# EAGLE schematic Resistor_Resistor (EAGLE 8.3.0), part 7 of 43
## Parts (continued)
R8784  10K  RESISTOR_0201  [0201]
R8785  10K  RESISTOR_0201  [0201]
R8786  10K  RESISTOR_0201  [0201]
R8787  10K  RESISTOR_0201  [0201]
R8788  10K  RESISTOR_0201  [0201]
R8789  10K  RESISTOR_0201  [0201]
R8790  10K  RESISTOR_0201  [0201]
R8791  10K  RESISTOR_0201  [0201]
R8792  10K  RESISTOR_0201  [0201]
R8793  10K  RESISTOR_0201  [0201]
R8794  10K  RESISTOR_0201  [0201]
R8795  10K  RESISTOR_0201  [0201]
R8796  10K  RESISTOR_0201  [0201]
R8797  10K  RESISTOR_0201  [0201]
R8798  10K  RESISTOR_0201  [0201]
R8799  10K  RESISTOR_0201  [0201]
R8800  10K  RESISTOR_0201  [0201]
R8801  10K  RESISTOR_0201  [0201]
R8802  10K  RESISTOR_0201  [0201]
R8803  10K  RESISTOR_0201  [0201]
R8804  10K  RESISTOR_0201  [0201]
R8805  10K  RESISTOR_0201  [0201]
R8806  10K  RESISTOR_0201  [0201]
R8807  10K  RESISTOR_0201  [0201]
R8808  10K  RESISTOR_0201  [0201]
R8809  10K  RESISTOR_0201  [0201]
R8810  10K  RESISTOR_0201  [0201]
R8811  10K  RESISTOR_0201  [0201]
R8812  10K  RESISTOR_0201  [0201]
R8813  10K  RESISTOR_0201  [0201]
R8814  10K  RESISTOR_0201  [0201]
R8815  10K  RESISTOR_0201  [0201]
R8816  10K  RESISTOR_0201  [0201]
R8817  10K  RESISTOR_0201  [0201]
R8818  10K  RESISTOR_0201  [0201]
R8819  10K  RESISTOR_0201  [0201]
R8820  10K  RESISTOR_0201  [0201]
R8821  10K  RESISTOR_0201  [0201]
R8822  10K  RESISTOR_0201  [0201]
R8823  10K  RESISTOR_0201  [0201]
R8824  10K  RESISTOR_0201  [0201]
R8825  10K  RESISTOR_0201  [0201]
R8826  10K  RESISTOR_0201  [0201]
R8827  10K  RESISTOR_0201  [0201]
R8828  10K  RESISTOR_0201  [0201]
R8829  10K  RESISTOR_0201  [0201]
R8830  10K  RESISTOR_0201  [0201]
R8831  10K  RESISTOR_0201  [0201]
R8832  10K  RESISTOR_0201  [0201]
R8833  10K  RESISTOR_0201  [0201]
R8834  10K  RESISTOR_0201  [0201]
R8835  10K  RESISTOR_0201  [0201]
R8836  10K  RESISTOR_0201  [0201]
R8837  10K  RESISTOR_0201  [0201]
R8838  10K  RESISTOR_0201  [0201]
R8839  10K  RESISTOR_0201  [0201]
R8840  10K  RESISTOR_0201  [0201]
R8841  10K  RESISTOR_0201  [0201]
R8842  10K  RESISTOR_0201  [0201]
R8843  10K  RESISTOR_0201  [0201]
R8844  10K  RESISTOR_0201  [0201]
R8845  10K  RESISTOR_0201  [0201]
R8846  10K  RESISTOR_0201  [0201]
R8847  10K  RESISTOR_0201  [0201]
R8848  10K  RESISTOR_0201  [0201]
R8849  10K  RESISTOR_0201  [0201]
R8850  10K  RESISTOR_0201  [0201]
R8851  10K  RESISTOR_0201  [0201]
R8852  10K  RESISTOR_0201  [0201]
R8853  10K  RESISTOR_0201  [0201]
R8854  10K  RESISTOR_0201  [0201]
R8855  10K  RESISTOR_0201  [0201]
R8856  10K  RESISTOR_0201  [0201]
R8857  10K  RESISTOR_0201  [0201]
R8858  10K  RESISTOR_0201  [0201]
R8859  10K  RESISTOR_0201  [0201]
R8860  10K  RESISTOR_0201  [0201]
R8861  10K  RESISTOR_0201  [0201]
R8862  10K  RESISTOR_0201  [0201]
R8863  10K  RESISTOR_0201  [0201]
R8864  10K  RESISTOR_0201  [0201]
R8865  10K  RESISTOR_0201  [0201]
R8866  10K  RESISTOR_0201  [0201]
R8867  10K  RESISTOR_0201  [0201]
R8868  10K  RESISTOR_0201  [0201]
R8869  10K  RESISTOR_0201  [0201]
R8870  10K  RESISTOR_0201  [0201]
R8871  10K  RESISTOR_0201  [0201]
R8872  10K  RESISTOR_0201  [0201]
R8873  10K  RESISTOR_0201  [0201]
R8874  10K  RESISTOR_0201  [0201]
R8875  10K  RESISTOR_0201  [0201]
R8876  10K  RESISTOR_0201  [0201]
R8877  10K  RESISTOR_0201  [0201]
R8878  10K  RESISTOR_0201  [0201]
R8879  10K  RESISTOR_0201  [0201]
R8880  10K  RESISTOR_0201  [0201]
R8881  10K  RESISTOR_0201  [0201]
R8882  10K  RESISTOR_0201  [0201]
R8883  10K  RESISTOR_0201  [0201]
R8884  10K  RESISTOR_0201  [0201]
R8885  10K  RESISTOR_0201  [0201]
R8886  10K  RESISTOR_0201  [0201]
R8887  10K  RESISTOR_0201  [0201]
R8888  10K  RESISTOR_0201  [0201]
R8889  10K  RESISTOR_0201  [0201]
R8890  10K  RESISTOR_0201  [0201]
R8891  10K  RESISTOR_0201  [0201]
R8892  10K  RESISTOR_0201  [0201]
R8893  10K  RESISTOR_0201  [0201]
R8894  10K  RESISTOR_0201  [0201]
R8895  10K  RESISTOR_0201  [0201]
R8896  10K  RESISTOR_0201  [0201]
R8897  10K  RESISTOR_0201  [0201]
R8898  10K  RESISTOR_0201  [0201]
R8899  10K  RESISTOR_0201  [0201]
R8900  10K  RESISTOR_0201  [0201]
R8901  10K  RESISTOR_0201  [0201]
R8902  10K  RESISTOR_0201  [0201]
R8903  10K  RESISTOR_0201  [0201]
R8904  10K  RESISTOR_0201  [0201]
R8905  10K  RESISTOR_0201  [0201]
R8906  10K  RESISTOR_0201  [0201]
R8907  10K  RESISTOR_0201  [0201]
R8908  10K  RESISTOR_0201  [0201]
R8909  10K  RESISTOR_0201  [0201]
R8910  10K  RESISTOR_0201  [0201]
R8911  10K  RESISTOR_0201  [0201]
R8912  10K  RESISTOR_0201  [0201]
R8913  10K  RESISTOR_0201  [0201]
R8914  10K  RESISTOR_0201  [0201]
R8915  10K  RESISTOR_0201  [0201]
R8916  10K  RESISTOR_0201  [0201]
R8917  10K  RESISTOR_0201  [0201]
R8918  10K  RESISTOR_0201  [0201]
R8919  10K  RESISTOR_0201  [0201]
R8920  10K  RESISTOR_0201  [0201]
R8921  10K  RESISTOR_0201  [0201]
R8922  10K  RESISTOR_0201  [0201]
R8923  10K  RESISTOR_0201  [0201]
R8924  10K  RESISTOR_0201  [0201]
R8925  10K  RESISTOR_0201  [0201]
R8926  10K  RESISTOR_0201  [0201]
R8927  10K  RESISTOR_0201  [0201]
R8928  10K  RESISTOR_0201  [0201]
R8929  10K  RESISTOR_0201  [0201]
R8930  10K  RESISTOR_0201  [0201]
R8931  10K  RESISTOR_0201  [0201]
R8932  10K  RESISTOR_0201  [0201]
R8933  10K  RESISTOR_0201  [0201]
R8934  10K  RESISTOR_0201  [0201]
R8935  10K  RESISTOR_0201  [0201]
R8936  10K  RESISTOR_0201  [0201]
R8937  10K  RESISTOR_0201  [0201]
R8938  10K  RESISTOR_0201  [0201]
R8939  10K  RESISTOR_0201  [0201]
R8940  10K  RESISTOR_0201  [0201]
R8941  10K  RESISTOR_0201  [0201]
R8942  10K  RESISTOR_0201  [0201]
R8943  10K  RESISTOR_0201  [0201]
R8944  10K  RESISTOR_0201  [0201]
R8945  10K  RESISTOR_0201  [0201]
R8946  10K  RESISTOR_0201  [0201]
R8947  10K  RESISTOR_0201  [0201]
R8948  10K  RESISTOR_0201  [0201]
R8949  10K  RESISTOR_0201  [0201]
R8950  10K  RESISTOR_0201  [0201]
R8951  10K  RESISTOR_0201  [0201]
R8952  10K  RESISTOR_0201  [0201]
R8953  10K  RESISTOR_0201  [0201]
R8954  10K  RESISTOR_0201  [0201]
R8955  10K  RESISTOR_0201  [0201]
R8956  10K  RESISTOR_0201  [0201]
R8957  10K  RESISTOR_0201  [0201]
R8958  10K  RESISTOR_0201  [0201]
R8959  10K  RESISTOR_0201  [0201]
R8960  10K  RESISTOR_0201  [0201]
R8961  10K  RESISTOR_0201  [0201]
R8962  10K  RESISTOR_0201  [0201]
R8963  10K  RESISTOR_0201  [0201]
R8964  10K  RESISTOR_0201  [0201]
R8965  10K  RESISTOR_0201  [0201]
R8966  10K  RESISTOR_0201  [0201]
R8967  10K  RESISTOR_0201  [0201]
R8968  10K  RESISTOR_0201  [0201]
R8969  10K  RESISTOR_0201  [0201]
R8970  10K  RESISTOR_0201  [0201]
R8971  10K  RESISTOR_0201  [0201]
R8972  10K  RESISTOR_0201  [0201]
R8973  10K  RESISTOR_0201  [0201]
R8974  10K  RESISTOR_0201  [0201]
R8975  10K  RESISTOR_0201  [0201]
R8976  10K  RESISTOR_0201  [0201]
R8977  10K  RESISTOR_0201  [0201]
R8978  10K  RESISTOR_0201  [0201]
R8979  10K  RESISTOR_0201  [0201]
R8980  10K  RESISTOR_0201  [0201]
R8981  10K  RESISTOR_0201  [0201]
R8982  10K  RESISTOR_0201  [0201]
R8983  10K  RESISTOR_0201  [0201]
R8984  10K  RESISTOR_0201  [0201]
R8985  10K  RESISTOR_0201  [0201]
R8986  10K  RESISTOR_0201  [0201]
R8987  10K  RESISTOR_0201  [0201]
R8988  10K  RESISTOR_0201  [0201]
R8989  10K  RESISTOR_0201  [0201]
R8990  10K  RESISTOR_0201  [0201]
R8991  10K  RESISTOR_0201  [0201]
R8992  10K  RESISTOR_0201  [0201]
R8993  10K  RESISTOR_0201  [0201]
R8994  10K  RESISTOR_0201  [0201]
R8995  10K  RESISTOR_0201  [0201]
R8996  10K  RESISTOR_0201  [0201]
R8997  10K  RESISTOR_0201  [0201]
R8998  10K  RESISTOR_0201  [0201]
R8999  10K  RESISTOR_0201  [0201]
R9000  10K  RESISTOR_0201  [0201]
R9001  10K  RESISTOR_0201  [0201]
R9002  10K  RESISTOR_0201  [0201]
R9003  10K  RESISTOR_0201  [0201]
R9004  10K  RESISTOR_0201  [0201]
R9005  10K  RESISTOR_0201  [0201]
R9006  10K  RESISTOR_0201  [0201]
R9007  10K  RESISTOR_0201  [0201]
R9008  10K  RESISTOR_0201  [0201]
R9009  10K  RESISTOR_0201  [0201]
R9010  10K  RESISTOR_0201  [0201]
R9011  10K  RESISTOR_0201  [0201]
R9012  10K  RESISTOR_0201  [0201]
R9013  10K  RESISTOR_0201  [0201]
R9014  10K  RESISTOR_0201  [0201]
R9015  10K  RESISTOR_0201  [0201]
R9016  10K  RESISTOR_0201  [0201]
R9017  10K  RESISTOR_0201  [0201]
R9018  10K  RESISTOR_0201  [0201]
R9019  10K  RESISTOR_0201  [0201]
R9020  10K  RESISTOR_0201  [0201]
R9021  10K  RESISTOR_0201  [0201]
R9022  10K  RESISTOR_0201  [0201]
R9023  10K  RESISTOR_0201  [0201]
R9024  10K  RESISTOR_0201  [0201]
R9025  10K  RESISTOR_0201  [0201]
R9026  10K  RESISTOR_0201  [0201]
R9027  10K  RESISTOR_0201  [0201]
R9028  10K  RESISTOR_0201  [0201]
R9029  10K  RESISTOR_0201  [0201]
R9030  10K  RESISTOR_0201  [0201]
R9031  10K  RESISTOR_0201  [0201]
R9032  10K  RESISTOR_0201  [0201]
R9033  10K  RESISTOR_0201  [0201]
R9034  10K  RESISTOR_0201  [0201]
R9035  10K  RESISTOR_0201  [0201]
R9036  10K  RESISTOR_0201  [0201]
R9037  10K  RESISTOR_0201  [0201]
R9038  10K  RESISTOR_0201  [0201]
R9039  10K  RESISTOR_0201  [0201]
R9040  10K  RESISTOR_0201  [0201]
R9041  10K  RESISTOR_0201  [0201]
R9042  10K  RESISTOR_0201  [0201]
R9043  10K  RESISTOR_0201  [0201]
R9044  10K  RESISTOR_0201  [0201]
R9045  10K  RESISTOR_0201  [0201]
R9046  10K  RESISTOR_0201  [0201]
R9047  10K  RESISTOR_0201  [0201]
R9048  10K  RESISTOR_0201  [0201]
R9049  10K  RESISTOR_0201  [0201]
R9050  10K  RESISTOR_0201  [0201]
R9051  10K  RESISTOR_0201  [0201]
R9052  10K  RESISTOR_0201  [0201]
R9053  10K  RESISTOR_0201  [0201]
R9054  10K  RESISTOR_0201  [0201]
R9055  10K  RESISTOR_0201  [0201]
R9056  10K  RESISTOR_0201  [0201]
R9057  10K  RESISTOR_0201  [0201]
R9058  10K  RESISTOR_0201  [0201]
R9059  10K  RESISTOR_0201  [0201]
R9060  10K  RESISTOR_0201  [0201]
R9061  10K  RESISTOR_0201  [0201]
R9062  10K  RESISTOR_0201  [0201]
R9063  10K  RESISTOR_0201  [0201]
R9064  10K  RESISTOR_0201  [0201]
R9065  10K  RESISTOR_0201  [0201]
R9066  10K  RESISTOR_0201  [0201]
R9067  10K  RESISTOR_0201  [0201]
R9068  10K  RESISTOR_0201  [0201]
R9069  10K  RESISTOR_0201  [0201]
R9070  10K  RESISTOR_0201  [0201]
R9071  10K  RESISTOR_0201  [0201]
R9072  10K  RESISTOR_0201  [0201]
R9073  10K  RESISTOR_0201  [0201]
R9074  10K  RESISTOR_0201  [0201]
R9075  10K  RESISTOR_0201  [0201]
R9076  10K  RESISTOR_0201  [0201]
R9077  10K  RESISTOR_0201  [0201]
R9078  10K  RESISTOR_0201  [0201]
R9079  10K  RESISTOR_0201  [0201]
R9080  10K  RESISTOR_0201  [0201]
R9081  10K  RESISTOR_0201  [0201]
R9082  10K  RESISTOR_0201  [0201]
R9083  10K  RESISTOR_0201  [0201]
R9084  10K  RESISTOR_0201  [0201]
R9085  10K  RESISTOR_0201  [0201]
R9086  10K  RESISTOR_0201  [0201]
R9087  10K  RESISTOR_0201  [0201]
R9088  10K  RESISTOR_0201  [0201]
R9089  10K  RESISTOR_0201  [0201]
R9090  10K  RESISTOR_0201  [0201]
R9091  10K  RESISTOR_0201  [0201]
R9092  10K  RESISTOR_0201  [0201]
R9093  10K  RESISTOR_0201  [0201]
R9094  10K  RESISTOR_0201  [0201]
R9095  10K  RESISTOR_0201  [0201]
R9096  10K  RESISTOR_0201  [0201]
R9097  10K  RESISTOR_0201  [0201]
R9098  10K  RESISTOR_0201  [0201]
R9099  10K  RESISTOR_0201  [0201]
R9100  10K  RESISTOR_0201  [0201]
R9101  10K  RESISTOR_0201  [0201]
R9102  10K  RESISTOR_0201  [0201]
R9103  10K  RESISTOR_0201  [0201]
R9104  10K  RESISTOR_0201  [0201]
R9105  10K  RESISTOR_0201  [0201]
R9106  10K  RESISTOR_0201  [0201]
R9107  10K  RESISTOR_0201  [0201]
R9108  10K  RESISTOR_0201  [0201]
R9109  10K  RESISTOR_0201  [0201]
R9110  10K  RESISTOR_0201  [0201]
R9111  10K  RESISTOR_0201  [0201]
R9112  10K  RESISTOR_0201  [0201]
R9113  10K  RESISTOR_0201  [0201]
R9114  10K  RESISTOR_0201  [0201]
R9115  10K  RESISTOR_0201  [0201]
R9116  10K  RESISTOR_0201  [0201]
R9117  10K  RESISTOR_0201  [0201]
R9118  10K  RESISTOR_0201  [0201]
R9119  10K  RESISTOR_0201  [0201]
R9120  10K  RESISTOR_0201  [0201]
R9121  10K  RESISTOR_0201  [0201]
R9122  10K  RESISTOR_0201  [0201]
R9123  10K  RESISTOR_0201  [0201]
R9124  10K  RESISTOR_0201  [0201]
R9125  10K  RESISTOR_0201  [0201]
R9126  10K  RESISTOR_0201  [0201]
R9127  10K  RESISTOR_0201  [0201]
R9128  10K  RESISTOR_0201  [0201]
R9129  10K  RESISTOR_0201  [0201]
R9130  10K  RESISTOR_0201  [0201]
R9131  10K  RESISTOR_0201  [0201]
R9132  10K  RESISTOR_0201  [0201]
R9133  10K  RESISTOR_0201  [0201]
R9134  10K  RESISTOR_0201  [0201]
R9135  10K  RESISTOR_0201  [0201]
R9136  10K  RESISTOR_0201  [0201]
R9137  10K  RESISTOR_0201  [0201]
R9138  10K  RESISTOR_0201  [0201]
R9139  10K  RESISTOR_0201  [0201]
R9140  10K  RESISTOR_0201  [0201]
R9141  10K  RESISTOR_0201  [0201]
R9142  10K  RESISTOR_0201  [0201]
R9143  10K  RESISTOR_0201  [0201]
R9144  10K  RESISTOR_0201  [0201]
R9145  10K  RESISTOR_0201  [0201]
R9146  10K  RESISTOR_0201  [0201]
R9147  10K  RESISTOR_0201  [0201]
R9148  10K  RESISTOR_0201  [0201]
R9149  10K  RESISTOR_0201  [0201]
R9150  10K  RESISTOR_0201  [0201]
R9151  10K  RESISTOR_0201  [0201]
R9152  10K  RESISTOR_0201  [0201]
R9153  10K  RESISTOR_0201  [0201]
R9154  10K  RESISTOR_0201  [0201]
R9155  10K  RESISTOR_0201  [0201]
R9156  10K  RESISTOR_0201  [0201]
R9157  10K  RESISTOR_0201  [0201]
R9158  10K  RESISTOR_0201  [0201]
R9159  10K  RESISTOR_0201  [0201]
R9160  10K  RESISTOR_0201  [0201]
R9161  10K  RESISTOR_0201  [0201]
R9162  10K  RESISTOR_0201  [0201]
R9163  10K  RESISTOR_0201  [0201]
R9164  10K  RESISTOR_0201  [0201]
R9165  10K  RESISTOR_0201  [0201]
R9166  10K  RESISTOR_0201  [0201]
R9167  10K  RESISTOR_0201  [0201]
R9168  10K  RESISTOR_0201  [0201]
R9169  10K  RESISTOR_0201  [0201]
R9170  10K  RESISTOR_0201  [0201]
R9171  10K  RESISTOR_0201  [0201]
R9172  10K  RESISTOR_0201  [0201]
R9173  10K  RESISTOR_0201  [0201]
R9174  10K  RESISTOR_0201  [0201]
R9175  10K  RESISTOR_0201  [0201]
R9176  10K  RESISTOR_0201  [0201]
R9177  10K  RESISTOR_0201  [0201]
R9178  10K  RESISTOR_0201  [0201]
R9179  10K  RESISTOR_0201  [0201]
R9180  10K  RESISTOR_0201  [0201]
R9181  10K  RESISTOR_0201  [0201]
R9182  10K  RESISTOR_0201  [0201]
R9183  10K  RESISTOR_0201  [0201]
R9184  10K  RESISTOR_0201  [0201]
R9185  10K  RESISTOR_0201  [0201]
R9186  10K  RESISTOR_0201  [0201]
R9187  10K  RESISTOR_0201  [0201]
R9188  10K  RESISTOR_0201  [0201]
R9189  10K  RESISTOR_0201  [0201]
R9190  10K  RESISTOR_0201  [0201]
R9191  10K  RESISTOR_0201  [0201]
R9192  10K  RESISTOR_0201  [0201]
R9193  10K  RESISTOR_0201  [0201]
R9194  10K  RESISTOR_0201  [0201]
R9195  10K  RESISTOR_0201  [0201]
R9196  10K  RESISTOR_0201  [0201]
R9197  10K  RESISTOR_0201  [0201]
R9198  10K  RESISTOR_0201  [0201]
R9199  10K  RESISTOR_0201  [0201]
R9200  10K  RESISTOR_0201  [0201]
R9201  10K  RESISTOR_0201  [0201]
R9202  10K  RESISTOR_0201  [0201]
R9203  10K  RESISTOR_0201  [0201]
R9204  10K  RESISTOR_0201  [0201]
R9205  10K  RESISTOR_0201  [0201]
R9206  10K  RESISTOR_0201  [0201]
R9207  10K  RESISTOR_0201  [0201]
R9208  10K  RESISTOR_0201  [0201]
R9209  10K  RESISTOR_0201  [0201]
R9210  10K  RESISTOR_0201  [0201]
R9211  10K  RESISTOR_0201  [0201]
R9212  10K  RESISTOR_0201  [0201]
R9213  10K  RESISTOR_0201  [0201]
R9214  10K  RESISTOR_0201  [0201]
R9215  10K  RESISTOR_0201  [0201]
R9216  10K  RESISTOR_0201  [0201]
R9217  10K  RESISTOR_0201  [0201]
R9218  10K  RESISTOR_0201  [0201]
R9219  10K  RESISTOR_0201  [0201]
R9220  10K  RESISTOR_0201  [0201]
R9221  10K  RESISTOR_0201  [0201]
R9222  10K  RESISTOR_0201  [0201]
R9223  10K  RESISTOR_0201  [0201]
R9224  10K  RESISTOR_0201  [0201]
R9225  10K  RESISTOR_0201  [0201]
R9226  10K  RESISTOR_0201  [0201]
R9227  10K  RESISTOR_0201  [0201]
R9228  10K  RESISTOR_0201  [0201]
R9229  10K  RESISTOR_0201  [0201]
R9230  10K  RESISTOR_0201  [0201]
R9231  10K  RESISTOR_0201  [0201]
R9232  10K  RESISTOR_0201  [0201]
R9233  10K  RESISTOR_0201  [0201]
R9234  10K  RESISTOR_0201  [0201]
R9235  10K  RESISTOR_0201  [0201]
R9236  10K  RESISTOR_0201  [0201]
R9237  10K  RESISTOR_0201  [0201]
R9238  10K  RESISTOR_0201  [0201]
R9239  10K  RESISTOR_0201  [0201]
R9240  10K  RESISTOR_0201  [0201]
R9241  10K  RESISTOR_0201  [0201]
R9242  10K  RESISTOR_0201  [0201]
R9243  10K  RESISTOR_0201  [0201]
R9244  10K  RESISTOR_0201  [0201]
R9245  10K  RESISTOR_0201  [0201]
R9246  10K  RESISTOR_0201  [0201]
R9247  10K  RESISTOR_0201  [0201]
R9248  10K  RESISTOR_0201  [0201]
R9249  10K  RESISTOR_0201  [0201]
R9250  10K  RESISTOR_0201  [0201]
R9251  10K  RESISTOR_0201  [0201]
R9252  10K  RESISTOR_0201  [0201]
R9253  10K  RESISTOR_0201  [0201]
R9254  10K  RESISTOR_0201  [0201]
R9255  10K  RESISTOR_0201  [0201]
R9256  10K  RESISTOR_0201  [0201]
R9257  10K  RESISTOR_0201  [0201]
R9258  10K  RESISTOR_0201  [0201]
R9259  10K  RESISTOR_0201  [0201]
R9260  10K  RESISTOR_0201  [0201]
R9261  10K  RESISTOR_0201  [0201]
R9262  10K  RESISTOR_0201  [0201]
R9263  10K  RESISTOR_0201  [0201]
R9264  10K  RESISTOR_0201  [0201]
R9265  10K  RESISTOR_0201  [0201]
R9266  10K  RESISTOR_0201  [0201]
R9267  10K  RESISTOR_0201  [0201]
R9268  10K  RESISTOR_0201  [0201]
R9269  10K  RESISTOR_0201  [0201]
R9270  10K  RESISTOR_0201  [0201]
R9271  10K  RESISTOR_0201  [0201]
R9272  10K  RESISTOR_0201  [0201]
R9273  10K  RESISTOR_0201  [0201]
R9274  10K  RESISTOR_0201  [0201]
R9275  10K  RESISTOR_0201  [0201]
R9276  10K  RESISTOR_0201  [0201]
R9277  10K  RESISTOR_0201  [0201]
R9278  10K  RESISTOR_0201  [0201]
R9279  10K  RESISTOR_0201  [0201]
R9280  10K  RESISTOR_0201  [0201]
R9281  10K  RESISTOR_0201  [0201]
R9282  10K  RESISTOR_0201  [0201]
R9283  10K  RESISTOR_0201  [0201]
R9284  10K  RESISTOR_0201  [0201]
R9285  10K  RESISTOR_0201  [0201]
R9286  10K  RESISTOR_0201  [0201]
R9287  10K  RESISTOR_0201  [0201]
R9288  10K  RESISTOR_0201  [0201]
R9289  10K  RESISTOR_0201  [0201]
R9290  10K  RESISTOR_0201  [0201]
R9291  10K  RESISTOR_0201  [0201]
R9292  10K  RESISTOR_0201  [0201]
R9293  10K  RESISTOR_0201  [0201]
R9294  10K  RESISTOR_0201  [0201]
R9295  10K  RESISTOR_0201  [0201]
R9296  10K  RESISTOR_0201  [0201]
R9297  10K  RESISTOR_0201  [0201]
R9298  10K  RESISTOR_0201  [0201]
R9299  10K  RESISTOR_0201  [0201]
R9300  10K  RESISTOR_0201  [0201]
R9301  10K  RESISTOR_0201  [0201]
R9302  10K  RESISTOR_0201  [0201]
R9303  10K  RESISTOR_0201  [0201]
R9304  10K  RESISTOR_0201  [0201]
R9305  10K  RESISTOR_0201  [0201]
R9306  10K  RESISTOR_0201  [0201]
R9307  10K  RESISTOR_0201  [0201]
R9308  10K  RESISTOR_0201  [0201]
R9309  10K  RESISTOR_0201  [0201]
R9310  10K  RESISTOR_0201  [0201]
R9311  10K  RESISTOR_0201  [0201]
R9312  10K  RESISTOR_0201  [0201]
R9313  10K  RESISTOR_0201  [0201]
R9314  10K  RESISTOR_0201  [0201]
R9315  10K  RESISTOR_0201  [0201]
R9316  10K  RESISTOR_0201  [0201]
R9317  10K  RESISTOR_0201  [0201]
R9318  10K  RESISTOR_0201  [0201]
R9319  10K  RESISTOR_0201  [0201]
R9320  10K  RESISTOR_0201  [0201]
R9321  10K  RESISTOR_0201  [0201]
R9322  10K  RESISTOR_0201  [0201]
R9323  10K  RESISTOR_0201  [0201]
R9324  10K  RESISTOR_0201  [0201]
R9325  10K  RESISTOR_0201  [0201]
R9326  10K  RESISTOR_0201  [0201]
R9327  10K  RESISTOR_0201  [0201]
R9328  10K  RESISTOR_0201  [0201]
R9329  10K  RESISTOR_0201  [0201]
R9330  10K  RESISTOR_0201  [0201]
R9331  10K  RESISTOR_0201  [0201]
R9332  10K  RESISTOR_0201  [0201]
R9333  10K  RESISTOR_0201  [0201]
R9334  10K  RESISTOR_0201  [0201]
R9335  10K  RESISTOR_0201  [0201]
R9336  10K  RESISTOR_0201  [0201]
R9337  10K  RESISTOR_0201  [0201]
R9338  10K  RESISTOR_0201  [0201]
R9339  10K  RESISTOR_0201  [0201]
R9340  10K  RESISTOR_0201  [0201]
R9341  10K  RESISTOR_0201  [0201]
R9342  10K  RESISTOR_0201  [0201]
R9343  10K  RESISTOR_0201  [0201]
R9344  10K  RESISTOR_0201  [0201]
R9345  10K  RESISTOR_0201  [0201]
R9346  10K  RESISTOR_0201  [0201]
R9347  10K  RESISTOR_0201  [0201]
R9348  10K  RESISTOR_0201  [0201]
R9349  10K  RESISTOR_0201  [0201]
R9350  10K  RESISTOR_0201  [0201]
R9351  10K  RESISTOR_0201  [0201]
R9352  10K  RESISTOR_0201  [0201]
R9353  10K  RESISTOR_0201  [0201]
R9354  10K  RESISTOR_0201  [0201]
R9355  10K  RESISTOR_0201  [0201]
R9356  10K  RESISTOR_0201  [0201]
R9357  10K  RESISTOR_0201  [0201]
R9358  10K  RESISTOR_0201  [0201]
R9359  10K  RESISTOR_0201  [0201]
R9360  10K  RESISTOR_0201  [0201]
R9361  10K  RESISTOR_0201  [0201]
R9362  10K  RESISTOR_0201  [0201]
R9363  10K  RESISTOR_0201  [0201]
R9364  10K  RESISTOR_0201  [0201]
R9365  10K  RESISTOR_0201  [0201]
R9366  10K  RESISTOR_0201  [0201]
R9367  10K  RESISTOR_0201  [0201]
R9368  10K  RESISTOR_0201  [0201]
R9369  10K  RESISTOR_0201  [0201]
R9370  10K  RESISTOR_0201  [0201]
R9371  10K  RESISTOR_0201  [0201]
R9372  10K  RESISTOR_0201  [0201]
R9373  10K  RESISTOR_0201  [0201]
R9374  10K  RESISTOR_0201  [0201]
R9375  10K  RESISTOR_0201  [0201]
R9376  10K  RESISTOR_0201  [0201]
R9377  10K  RESISTOR_0201  [0201]
R9378  10K  RESISTOR_0201  [0201]
R9379  10K  RESISTOR_0201  [0201]
R9380  10K  RESISTOR_0201  [0201]
R9381  10K  RESISTOR_0201  [0201]
R9382  10K  RESISTOR_0201  [0201]
R9383  10K  RESISTOR_0201  [0201]
R9384  10K  RESISTOR_0201  [0201]
R9385  10K  RESISTOR_0201  [0201]
R9386  10K  RESISTOR_0201  [0201]
R9387  10K  RESISTOR_0201  [0201]
R9388  10K  RESISTOR_0201  [0201]
R9389  10K  RESISTOR_0201  [0201]
R9390  10K  RESISTOR_0201  [0201]
R9391  10K  RESISTOR_0201  [0201]
R9392  10K  RESISTOR_0201  [0201]
R9393  10K  RESISTOR_0201  [0201]
R9394  10K  RESISTOR_0201  [0201]
R9395  10K  RESISTOR_0201  [0201]
R9396  10K  RESISTOR_0201  [0201]
R9397  10K  RESISTOR_0201  [0201]
R9398  10K  RESISTOR_0201  [0201]
R9399  10K  RESISTOR_0201  [0201]
R9400  10K  RESISTOR_0201  [0201]
R9401  10K  RESISTOR_0201  [0201]
R9402  10K  RESISTOR_0201  [0201]
R9403  10K  RESISTOR_0201  [0201]
R9404  10K  RESISTOR_0201  [0201]
R9405  10K  RESISTOR_0201  [0201]
R9406  10K  RESISTOR_0201  [0201]
R9407  10K  RESISTOR_0201  [0201]
R9408  10K  RESISTOR_0201  [0201]
R9409  10K  RESISTOR_0201  [0201]
R9410  10K  RESISTOR_0201  [0201]
R9411  10K  RESISTOR_0201  [0201]
R9412  10K  RESISTOR_0201  [0201]
R9413  10K  RESISTOR_0201  [0201]
R9414  10K  RESISTOR_0201  [0201]
R9415  10K  RESISTOR_0201  [0201]
R9416  10K  RESISTOR_0201  [0201]
R9417  10K  RESISTOR_0201  [0201]
R9418  10K  RESISTOR_0201  [0201]
R9419  10K  RESISTOR_0201  [0201]
R9420  10K  RESISTOR_0201  [0201]
R9421  10K  RESISTOR_0201  [0201]
R9422  10K  RESISTOR_0201  [0201]
R9423  10K  RESISTOR_0201  [0201]
R9424  10K  RESISTOR_0201  [0201]
R9425  10K  RESISTOR_0201  [0201]
R9426  10K  RESISTOR_0201  [0201]
R9427  10K  RESISTOR_0201  [0201]
R9428  10K  RESISTOR_0201  [0201]
R9429  10K  RESISTOR_0201  [0201]
R9430  10K  RESISTOR_0201  [0201]
R9431  10K  RESISTOR_0201  [0201]
R9432  10K  RESISTOR_0201  [0201]
R9433  10K  RESISTOR_0201  [0201]
R9434  10K  RESISTOR_0201  [0201]
R9435  10K  RESISTOR_0201  [0201]
R9436  10K  RESISTOR_0201  [0201]
R9437  10K  RESISTOR_0201  [0201]
R9438  10K  RESISTOR_0201  [0201]
R9439  10K  RESISTOR_0201  [0201]
R9440  10K  RESISTOR_0201  [0201]
R9441  10K  RESISTOR_0201  [0201]
R9442  10K  RESISTOR_0201  [0201]
R9443  10K  RESISTOR_0201  [0201]
R9444  10K  RESISTOR_0201  [0201]
R9445  10K  RESISTOR_0201  [0201]
R9446  10K  RESISTOR_0201  [0201]
R9447  10K  RESISTOR_0201  [0201]
R9448  10K  RESISTOR_0201  [0201]
R9449  10K  RESISTOR_0201  [0201]
R9450  10K  RESISTOR_0201  [0201]
R9451  10K  RESISTOR_0201  [0201]
R9452  10K  RESISTOR_0201  [0201]
R9453  10K  RESISTOR_0201  [0201]
R9454  10K  RESISTOR_0201  [0201]
R9455  10K  RESISTOR_0201  [0201]
R9456  10K  RESISTOR_0201  [0201]
R9457  10K  RESISTOR_0201  [0201]
R9458  10K  RESISTOR_0201  [0201]
R9459  10K  RESISTOR_0201  [0201]
R9460  10K  RESISTOR_0201  [0201]
R9461  10K  RESISTOR_0201  [0201]
R9462  10K  RESISTOR_0201  [0201]
R9463  10K  RESISTOR_0201  [0201]
R9464  10K  RESISTOR_0201  [0201]
R9465  10K  RESISTOR_0201  [0201]
R9466  10K  RESISTOR_0201  [0201]
R9467  10K  RESISTOR_0201  [0201]
R9468  10K  RESISTOR_0201  [0201]
R9469  10K  RESISTOR_0201  [0201]
R9470  10K  RESISTOR_0201  [0201]
R9471  10K  RESISTOR_0201  [0201]
R9472  10K  RESISTOR_0201  [0201]
R9473  10K  RESISTOR_0201  [0201]
R9474  10K  RESISTOR_0201  [0201]
R9475  10K  RESISTOR_0201  [0201]
R9476  10K  RESISTOR_0201  [0201]
R9477  10K  RESISTOR_0201  [0201]
R9478  10K  RESISTOR_0201  [0201]
R9479  10K  RESISTOR_0201  [0201]
R9480  10K  RESISTOR_0201  [0201]
R9481  10K  RESISTOR_0201  [0201]
R9482  10K  RESISTOR_0201  [0201]
R9483  10K  RESISTOR_0201  [0201]
R9484  10K  RESISTOR_0201  [0201]
R9485  10K  RESISTOR_0201  [0201]
R9486  10K  RESISTOR_0201  [0201]
R9487  10K  RESISTOR_0201  [0201]
R9488  10K  RESISTOR_0201  [0201]
R9489  10K  RESISTOR_0201  [0201]
R9490  10K  RESISTOR_0201  [0201]
R9491  10K  RESISTOR_0201  [0201]
R9492  10K  RESISTOR_0201  [0201]
R9493  10K  RESISTOR_0201  [0201]
R9494  10K  RESISTOR_0201  [0201]
R9495  10K  RESISTOR_0201  [0201]
R9496  10K  RESISTOR_0201  [0201]
R9497  10K  RESISTOR_0201  [0201]
R9498  10K  RESISTOR_0201  [0201]
R9499  10K  RESISTOR_0201  [0201]
R9500  10K  RESISTOR_0201  [0201]
R9501  10K  RESISTOR_0201  [0201]
R9502  10K  RESISTOR_0201  [0201]
R9503  10K  RESISTOR_0201  [0201]
R9504  10K  RESISTOR_0201  [0201]
R9505  10K  RESISTOR_0201  [0201]
R9506  10K  RESISTOR_0201  [0201]
R9507  10K  RESISTOR_0201  [0201]
R9508  10K  RESISTOR_0201  [0201]
R9509  10K  RESISTOR_0201  [0201]
R9510  10K  RESISTOR_0201  [0201]
R9511  10K  RESISTOR_0201  [0201]
R9512  10K  RESISTOR_0201  [0201]
R9513  10K  RESISTOR_0201  [0201]